# EasyEDA Pro project kuafu01_030内部老化方案.eprj, board PCB4 (continued)
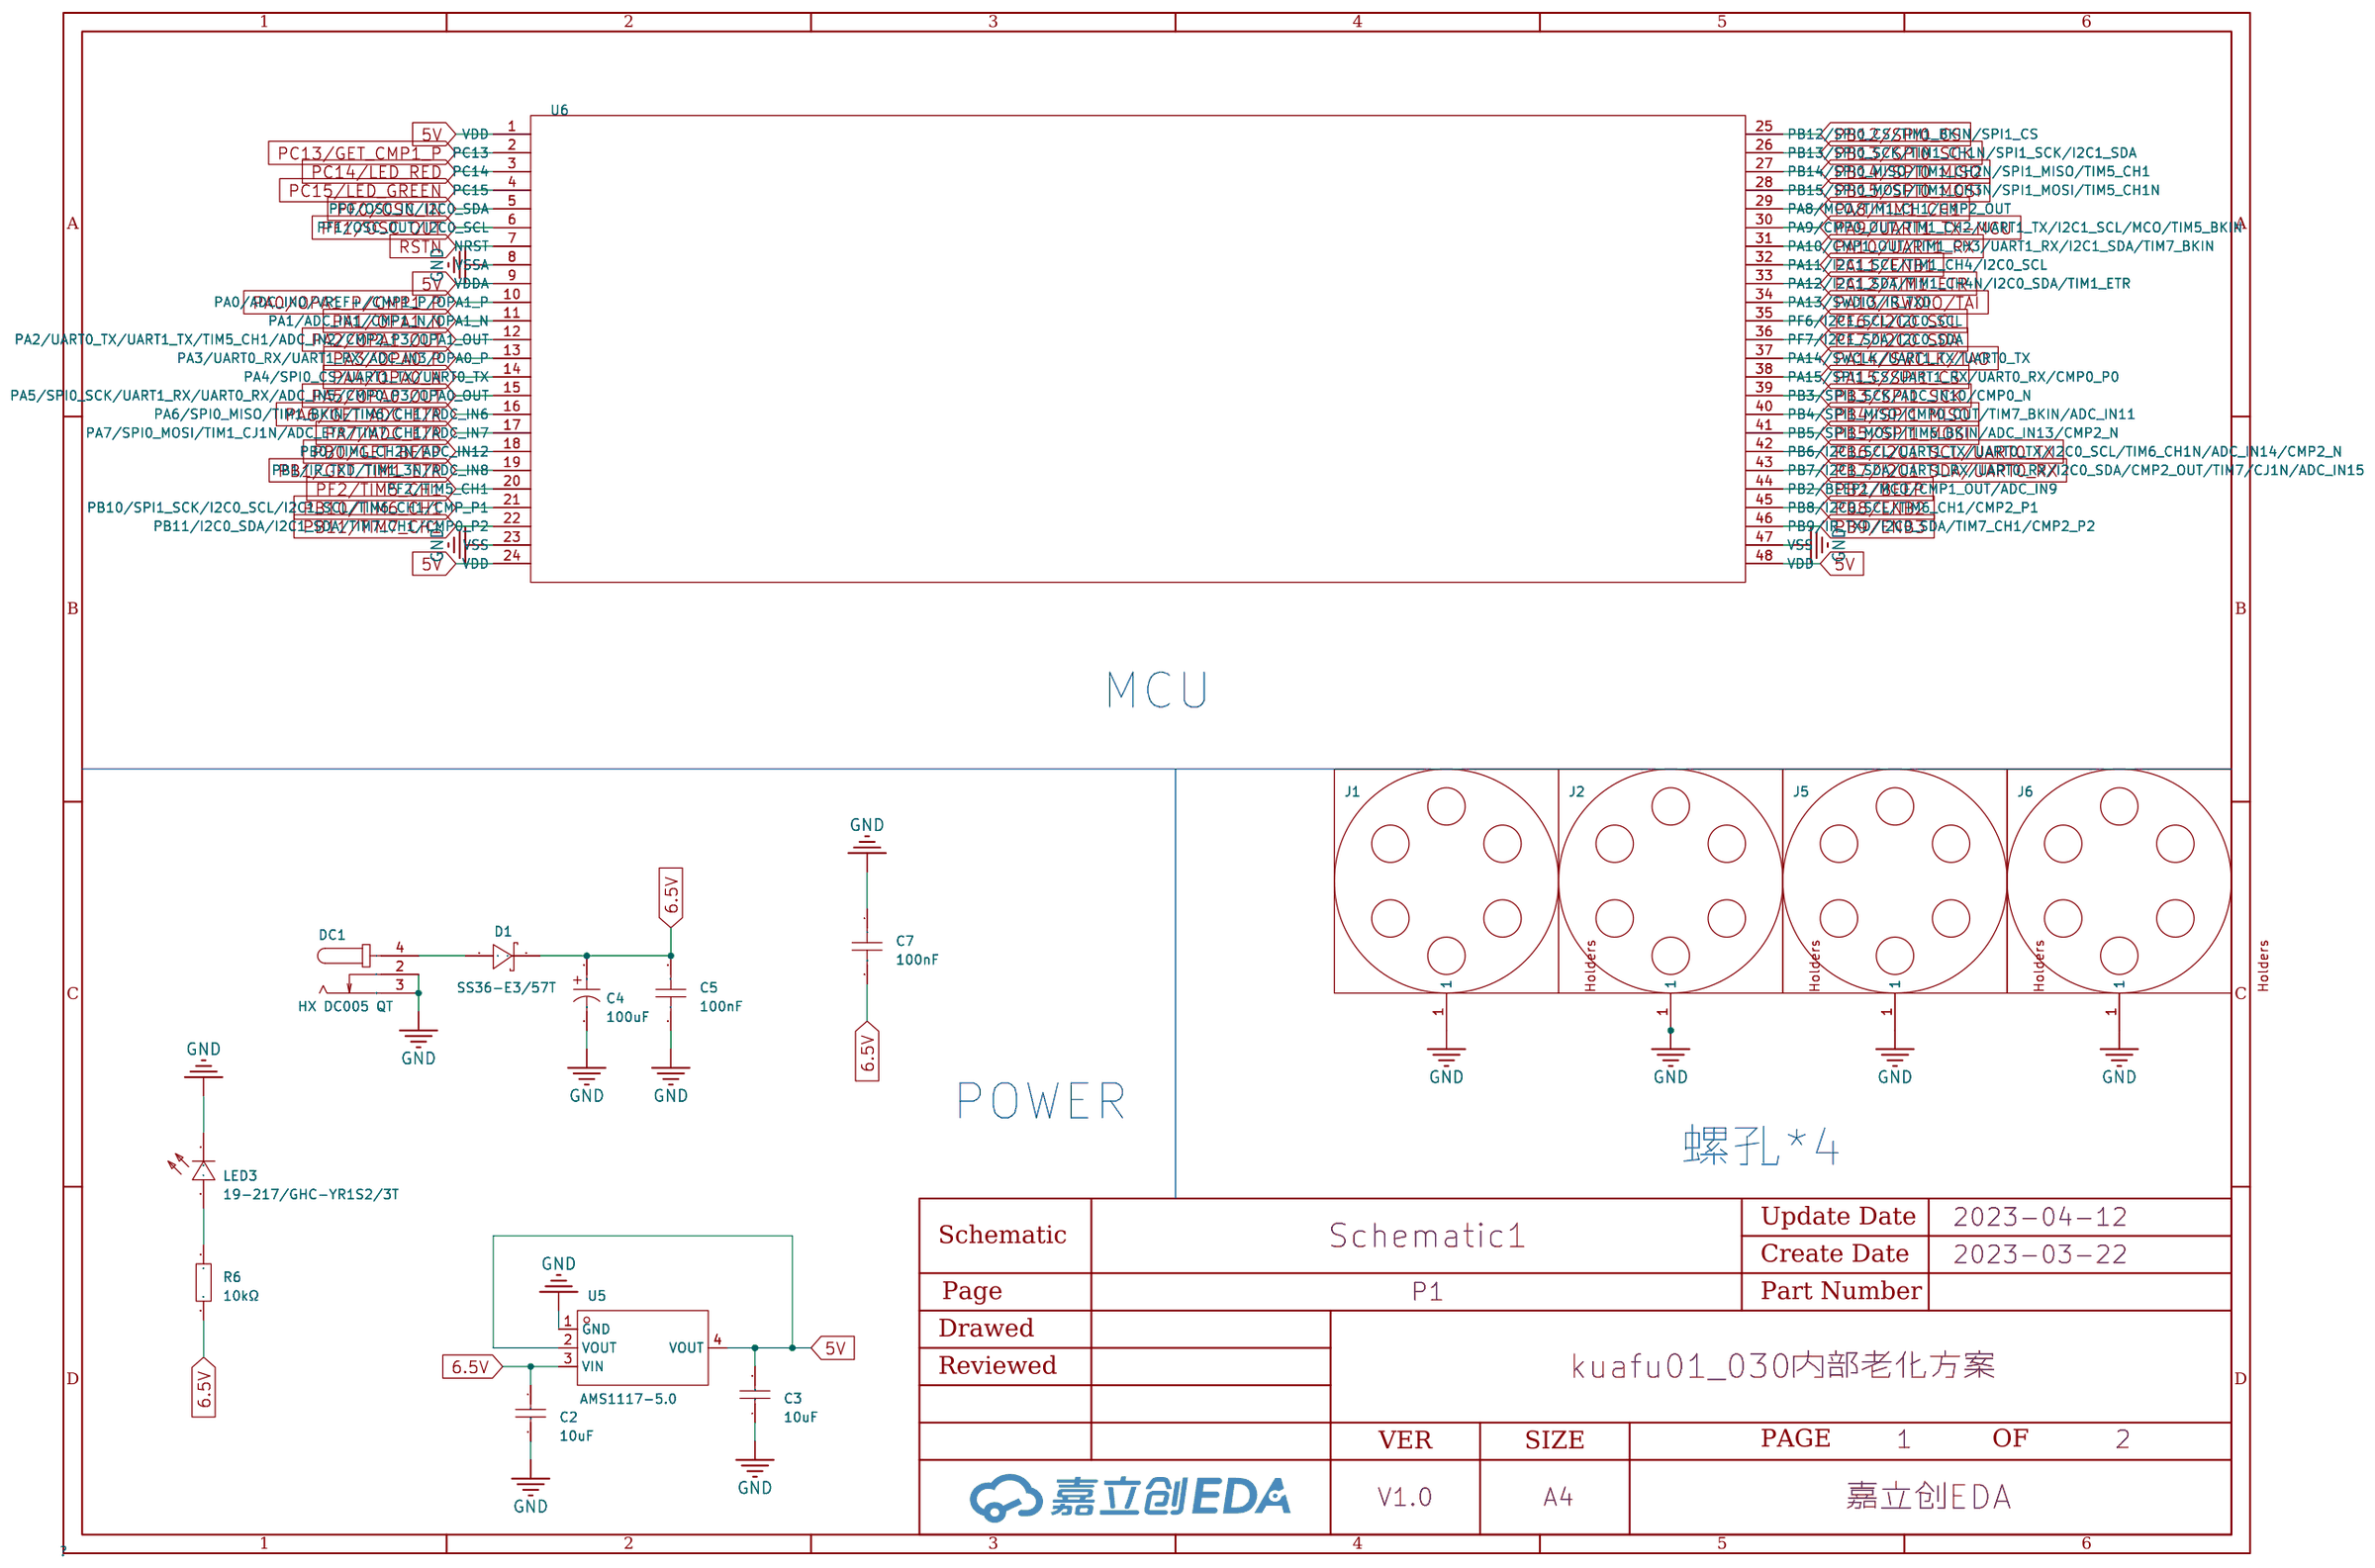
[diagram p0: P1]
## Routing (per net, layer and track width the routed paths; a pad name or vN(x,y) marks a point on that pad's centre or on a via; arc(x,y) is an arc through that point) (continued)
  Bottom Layer w0.381: v1(111.26,23.36) 111.16,23.47 111.16,31.54 110.28,32.42 109.28,32.42 v1(108.42,31.56) ; v1(260.82,133.16) 261.68,134.02 262.68,134.02 263.56,133.14 263.56,125.07 v1(263.66,124.96) ; v1(57.62,82.36) 58.48,83.22 59.48,83.22 60.36,82.34 60.36,74.27 v1(60.46,74.16) ; v1(240.62,22.94) 240.62,20.89 v1(240.61,20.88) ; v1(98.77,52.12) 99.2,52.55 107.4,52.55 109.12,50.84 109.12,47.96 106.27,45.11 106.27,41.39 106.22,41.33 106.22,40.16 106.16,40.1 v1(106.12,40.1) ; v1(189.82,124.54) 189.82,122.49 v1(189.81,122.48) ; v1(189.82,175.34) 189.82,173.29 v1(189.81,173.28) ; v1(210.02,31.56) 210.88,32.42 211.88,32.42 212.76,31.54 212.76,23.47 v1(212.86,23.36) ; v1(57.62,285.56) 58.48,286.42 59.48,286.42 60.36,285.54 60.36,277.47 v1(60.46,277.36) ; v1(189.82,276.94) 189.82,274.89 v1(189.81,274.88) ; v1(291.42,327.74) 291.42,325.69 v1(291.41,325.68) ; v1(37.41,173.28) 37.42,173.29 v1(37.42,175.34) ; v1(309.32,141.7) 309.36,141.7 309.42,141.76 309.42,142.93 309.47,142.99 309.47,146.71 312.32,149.56 312.32,152.44 310.6,154.15 302.4,154.15 v1(301.97,153.72) ; v1(260.82,31.56) 261.68,32.42 262.68,32.42 263.56,31.54 263.56,23.47 v1(263.66,23.36) ; v1(159.22,234.76) 160.08,235.62 161.08,235.62 161.96,234.74 161.96,226.67 v1(162.06,226.56) ; v1(159.22,336.36) 160.08,337.22 161.08,337.22 161.96,336.34 161.96,328.27 v1(162.06,328.16) ; v1(55.32,192.5) 55.36,192.5 55.42,192.56 55.42,193.73 55.47,193.79 55.47,197.51 58.32,200.36 58.32,203.24 56.6,204.95 48.4,204.95 v1(47.97,204.52) ; v1(111.26,277.36) 111.16,277.47 111.16,285.54 110.28,286.42 109.28,286.42 v1(108.42,285.56) ; v1(260.82,336.36) 261.68,337.22 262.68,337.22 263.56,336.34 263.56,328.27 v1(263.66,328.16) ; v1(200.37,52.12) 200.8,52.55 209,52.55 210.72,50.84 210.72,47.96 207.87,45.11 207.87,41.39 207.82,41.33 207.82,40.16 207.76,40.1 v1(207.72,40.1) ; v1(88.21,20.88) 88.22,20.89 v1(88.22,22.94) ; v1(309.32,344.9) 309.36,344.9 309.42,344.96 309.42,346.13 309.47,346.19 309.47,349.91 312.32,352.76 312.32,355.64 310.6,357.35 302.4,357.35 v1(301.97,356.92) ; v1(311.62,285.56) 312.48,286.42 313.48,286.42 314.36,285.54 314.36,277.47 v1(314.46,277.36) ; v1(240.61,122.48) 240.62,122.49 v1(240.62,124.54) ; v1(240.62,276.94) 240.62,274.89 v1(240.61,274.88) ; v1(139.01,274.88) 139.02,274.89 v1(139.02,276.94) ; v1(47.97,153.72) 48.4,154.15 56.6,154.15 58.32,152.44 58.32,149.56 55.47,146.71 55.47,142.99 55.42,142.93 55.42,141.76 55.36,141.7 v1(55.32,141.7) ; v1(108.42,183.96) 109.28,184.82 110.28,184.82 111.16,183.94 111.16,175.87 v1(111.26,175.76) ; v1(200.37,306.12) 200.8,306.55 209,306.55 210.72,304.84 210.72,301.96 207.87,299.11 207.87,295.39 207.82,295.33 207.82,294.16 207.76,294.1 v1(207.72,294.1) ; v1(189.82,226.14) 189.82,224.09 v1(189.81,224.08) ; v1(149.57,102.92) 150,103.35 158.2,103.35 159.92,101.64 159.92,98.76 157.07,95.91 157.07,92.19 157.02,92.13 157.02,90.96 156.96,90.9 v1(156.92,90.9) ; v1(200.37,204.52) 200.8,204.95 209,204.95 210.72,203.24 210.72,200.36 207.87,197.51 207.87,193.79 207.82,193.73 207.82,192.56 207.76,192.5 v1(207.72,192.5) ; v1(156.92,344.9) 156.96,344.9 157.02,344.96 157.02,346.13 157.07,346.19 157.07,349.91 159.92,352.76 159.92,355.64 158.2,357.35 150,357.35 v1(149.57,356.92) ; v1(311.62,82.36) 312.48,83.22 313.48,83.22 314.36,82.34 314.36,74.27 v1(314.46,74.16) ; v1(139.01,20.88) 139.02,20.89 v1(139.02,22.94) ; v1(311.62,183.96) 312.48,184.82 313.48,184.82 314.36,183.94 314.36,175.87 v1(314.46,175.76) ; v1(189.82,327.74) 189.82,325.69 v1(189.81,325.68) ; v1(98.77,255.32) 99.2,255.75 107.4,255.75 109.12,254.04 109.12,251.16 106.27,248.31 106.27,244.59 106.22,244.53 106.22,243.36 106.16,243.3 v1(106.12,243.3) ; v1(240.62,226.14) 240.62,224.09 v1(240.61,224.08) ; v1(106.12,141.7) 106.16,141.7 106.22,141.76 106.22,142.93 106.27,142.99 106.27,146.71 109.12,149.56 109.12,152.44 107.4,154.15 99.2,154.15 v1(98.77,153.72) ; v1(57.62,133.16) 58.48,134.02 59.48,134.02 60.36,133.14 60.36,125.07 v1(60.46,124.96) ; v1(139.02,175.34) 139.02,173.29 v1(139.01,173.28) ; v1(301.97,255.32) 302.4,255.75 310.6,255.75 312.32,254.04 312.32,251.16 309.47,248.31 309.47,244.59 309.42,244.53 309.42,243.36 309.36,243.3 v1(309.32,243.3) ; v1(88.22,226.14) 88.22,224.09 v1(88.21,224.08) ; v1(139.01,71.68) 139.02,71.69 v1(139.02,73.74) ; v1(162.06,74.16) 161.96,74.27 161.96,82.34 161.08,83.22 160.08,83.22 v1(159.22,82.36) ; v1(162.06,175.76) 161.96,175.87 161.96,183.94 161.08,184.82 160.08,184.82 v1(159.22,183.96) ; v1(156.92,294.1) 156.96,294.1 157.02,294.16 157.02,295.33 157.07,295.39 157.07,299.11 159.92,301.96 159.92,304.84 158.2,306.55 150,306.55 v1(149.57,306.12) ; v1(210.02,133.16) 210.88,134.02 211.88,134.02 212.76,133.14 212.76,125.07 v1(212.86,124.96) ; v1(251.17,356.92) 251.6,357.35 259.8,357.35 261.52,355.64 261.52,352.76 258.67,349.91 258.67,346.19 258.62,346.13 258.62,344.96 258.56,344.9 v1(258.52,344.9) ; v1(106.12,344.9) 106.16,344.9 106.22,344.96 106.22,346.13 106.27,346.19 106.27,349.91 109.12,352.76 109.12,355.64 107.4,357.35 99.2,357.35 v1(98.77,356.92) ; v1(240.62,73.74) 240.62,71.69 v1(240.61,71.68) ; v1(309.32,192.5) 309.36,192.5 309.42,192.56 309.42,193.73 309.47,193.79 309.47,197.51 312.32,200.36 312.32,203.24 310.6,204.95 302.4,204.95 v1(301.97,204.52) ; v1(258.52,90.9) 258.56,90.9 258.62,90.96 258.62,92.13 258.67,92.19 258.67,95.91 261.52,98.76 261.52,101.64 259.8,103.35 251.6,103.35 v1(251.17,102.92) ; v1(200.37,255.32) 200.8,255.75 209,255.75 210.72,254.04 210.72,251.16 207.87,248.31 207.87,244.59 207.82,244.53 207.82,243.36 207.76,243.3 v1(207.72,243.3) ; v1(251.17,204.52) 251.6,204.95 259.8,204.95 261.52,203.24 261.52,200.36 258.67,197.51 258.67,193.79 258.62,193.73 258.62,192.56 258.56,192.5 v1(258.52,192.5) ; v1(309.32,294.1) 309.36,294.1 309.42,294.16 309.42,295.33 309.47,295.39 309.47,299.11 312.32,301.96 312.32,304.84 310.6,306.55 302.4,306.55 v1(301.97,306.12) ; v1(260.82,285.56) 261.68,286.42 262.68,286.42 263.56,285.54 263.56,277.47 v1(263.66,277.36) ; v1(159.22,285.56) 160.08,286.42 161.08,286.42 161.96,285.54 161.96,277.47 v1(162.06,277.36) ; v1(189.82,73.74) 189.82,71.69 v1(189.81,71.68) ; v1(291.41,173.28) 291.42,173.29 v1(291.42,175.34) ; v1(212.86,74.16) 212.76,74.27 212.76,82.34 211.88,83.22 210.88,83.22 v1(210.02,82.36) ; v1(88.21,325.68) 88.22,325.69 v1(88.22,327.74) ; v1(55.32,40.1) 55.36,40.1 55.42,40.16 55.42,41.33 55.47,41.39 55.47,45.11 58.32,47.96 58.32,50.84 56.6,52.55 48.4,52.55 v1(47.97,52.12) ; v1(309.32,90.9) 309.36,90.9 309.42,90.96 309.42,92.13 309.47,92.19 309.47,95.91 312.32,98.76 312.32,101.64 310.6,103.35 302.4,103.35 v1(301.97,102.92) ; v1(60.46,175.76) 60.36,175.87 60.36,183.94 59.48,184.82 58.48,184.82 v1(57.62,183.96) ; v1(111.26,74.16) 111.16,74.27 111.16,82.34 110.28,83.22 109.28,83.22 v1(108.42,82.36) ; v1(210.02,183.96) 210.88,184.82 211.88,184.82 212.76,183.94 212.76,175.87 v1(212.86,175.76) ; v1(88.22,276.94) 88.22,274.89 v1(88.21,274.88) ; v1(210.02,285.56) 210.88,286.42 211.88,286.42 212.76,285.54 212.76,277.47 v1(212.86,277.36) ; v1(98.77,102.92) 99.2,103.35 107.4,103.35 109.12,101.64 109.12,98.76 106.27,95.91 106.27,92.19 106.22,92.13 106.22,90.96 106.16,90.9 v1(106.12,90.9) ; v1(258.52,40.1) 258.56,40.1 258.62,40.16 258.62,41.33 258.67,41.39 258.67,45.11 261.52,47.96 261.52,50.84 259.8,52.55 251.6,52.55 v1(251.17,52.12) ; v1(37.41,122.48) 37.42,122.49 v1(37.42,124.54) ; v1(106.12,192.5) 106.16,192.5 106.22,192.56 106.22,193.73 106.27,193.79 106.27,197.51 109.12,200.36 109.12,203.24 107.4,204.95 99.2,204.95 v1(98.77,204.52) ; v1(263.66,226.56) 263.56,226.67 263.56,234.74 262.68,235.62 261.68,235.62 v1(260.82,234.76) ; v1(291.42,73.74) 291.42,71.69 v1(291.41,71.68) ; v1(149.57,52.12) 150,52.55 158.2,52.55 159.92,50.84 159.92,47.96 157.07,45.11 157.07,41.39 157.02,41.33 157.02,40.16 156.96,40.1 v1(156.92,40.1) ; v1(251.17,306.12) 251.6,306.55 259.8,306.55 261.52,304.84 261.52,301.96 258.67,299.11 258.67,295.39 258.62,295.33 258.62,294.16 258.56,294.1 v1(258.52,294.1) ; v1(314.46,328.16) 314.36,328.27 314.36,336.34 313.48,337.22 312.48,337.22 v1(311.62,336.36) ; v1(260.82,82.36) 261.68,83.22 262.68,83.22 263.56,82.34 263.56,74.27 v1(263.66,74.16) ; v1(212.86,328.16) 212.76,328.27 212.76,336.34 211.88,337.22 210.88,337.22 v1(210.02,336.36) ; v1(139.02,124.54) 139.02,122.49 v1(139.01,122.48) ; v1(207.72,90.9) 207.76,90.9 207.82,90.96 207.82,92.13 207.87,92.19 207.87,95.91 210.72,98.76 210.72,101.64 209,103.35 200.8,103.35 v1(200.37,102.92) ; v1(88.21,122.48) 88.22,122.49 v1(88.22,124.54) ; v1(108.42,234.76) 109.28,235.62 110.28,235.62 111.16,234.74 111.16,226.67 v1(111.26,226.56) ; v1(139.02,327.74) 139.02,325.69 v1(139.01,325.68) ; v1(111.26,328.16) 111.16,328.27 111.16,336.34 110.28,337.22 109.28,337.22 v1(108.42,336.36) ; v1(98.77,306.12) 99.2,306.55 107.4,306.55 109.12,304.84 109.12,301.96 106.27,299.11 106.27,295.39 106.22,295.33 106.22,294.16 106.16,294.1 v1(106.12,294.1) ; v1(47.97,255.32) 48.4,255.75 56.6,255.75 58.32,254.04 58.32,251.16 55.47,248.31 55.47,244.59 55.42,244.53 55.42,243.36 55.36,243.3 v1(55.32,243.3) ; v1(207.72,141.7) 207.76,141.7 207.82,141.76 207.82,142.93 207.87,142.99 207.87,146.71 210.72,149.56 210.72,152.44 209,154.15 200.8,154.15 v1(200.37,153.72) ; v1(212.86,226.56) 212.76,226.67 212.76,234.74 211.88,235.62 210.88,235.62 v1(210.02,234.76) ; v1(149.57,153.72) 150,154.15 158.2,154.15 159.92,152.44 159.92,149.56 157.07,146.71 157.07,142.99 157.02,142.93 157.02,141.76 156.96,141.7 v1(156.92,141.7) ; v1(162.06,23.36) 161.96,23.47 161.96,31.54 161.08,32.42 160.08,32.42 v1(159.22,31.56) ; v1(156.92,192.5) 156.96,192.5 157.02,192.56 157.02,193.73 157.07,193.79 157.07,197.51 159.92,200.36 159.92,203.24 158.2,204.95 150,204.95 v1(149.57,204.52) ; v1(291.41,274.88) 291.42,274.89 v1(291.42,276.94) ; v1(291.41,122.48) 291.42,122.49 v1(291.42,124.54) ; v1(207.72,344.9) 207.76,344.9 207.82,344.96 207.82,346.13 207.87,346.19 207.87,349.91 210.72,352.76 210.72,355.64 209,357.35 200.8,357.35 v1(200.37,356.92) ; v1(139.01,224.08) 139.02,224.09 v1(139.02,226.14) ; v1(88.21,71.68) 88.22,71.69 v1(88.22,73.74) ; v1(251.17,153.72) 251.6,154.15 259.8,154.15 261.52,152.44 261.52,149.56 258.67,146.71 258.67,142.99 258.62,142.93 258.62,141.76 258.56,141.7 v1(258.52,141.7) ; v1(260.82,183.96) 261.68,184.82 262.68,184.82 263.56,183.94 263.56,175.87 v1(263.66,175.76) ; v1(311.62,234.76) 312.48,235.62 313.48,235.62 314.36,234.74 314.36,226.67 v1(314.46,226.56) ; v1(189.82,22.94) 189.82,20.89 v1(189.81,20.88) ; v1(37.41,224.08) 37.42,224.09 v1(37.42,226.14) ; v1(162.06,124.96) 161.96,125.07 161.96,133.14 161.08,134.02 160.08,134.02 v1(159.22,133.16) ; v1(60.46,226.56) 60.36,226.67 60.36,234.74 59.48,235.62 58.48,235.62 v1(57.62,234.76) ; v1(88.21,173.28) 88.22,173.29 v1(88.22,175.34) ; v1(311.62,133.16) 312.48,134.02 313.48,134.02 314.36,133.14 314.36,125.07 v1(314.46,124.96) ; v1(47.97,102.92) 48.4,103.35 56.6,103.35 58.32,101.64 58.32,98.76 55.47,95.91 55.47,92.19 55.42,92.13 55.42,90.96 55.36,90.9 v1(55.32,90.9) ; v1(258.52,243.3) 258.56,243.3 258.62,243.36 258.62,244.53 258.67,244.59 258.67,248.31 261.52,251.16 261.52,254.04 259.8,255.75 251.6,255.75 v1(251.17,255.32) ; v1(55.32,294.1) 55.36,294.1 55.42,294.16 55.42,295.33 55.47,295.39 55.47,299.11 58.32,301.96 58.32,304.84 56.6,306.55 48.4,306.55 v1(47.97,306.12) ; v1(57.62,31.56) 58.48,32.42 59.48,32.42 60.36,31.54 60.36,23.47 v1(60.46,23.36) ; v1(156.92,243.3) 156.96,243.3 157.02,243.36 157.02,244.53 157.07,244.59 157.07,248.31 159.92,251.16 159.92,254.04 158.2,255.75 150,255.75 v1(149.57,255.32) ; v1(291.42,226.14) 291.42,224.09 v1(291.41,224.08) ; v1(240.61,173.28) 240.62,173.29 v1(240.62,175.34) ; v1(111.26,124.96) 111.16,125.07 111.16,133.14 110.28,134.02 109.28,134.02 v1(108.42,133.16) ; v1(37.41,71.68) 37.42,71.69 v1(37.42,73.74) ; v1(240.61,325.68) 240.62,325.69 v1(240.62,327.74) ; v1(37.42,22.94) 37.42,20.89 v1(37.41,20.88) ; v1(37.41,274.88) 37.42,274.89 v1(37.42,276.94)
  Bottom Layer w0.508: v1(251.17,306.12) 251.17,309.92 v1(251.21,309.97) ; v1(240.62,73.74) 236.94,77.43 v1(236.94,80.16) ; 244.03,277.73 244.03,279.75 245.96,281.69 245.96,288.24 v1(245.97,288.25) 245.97,288.25 v1(245.97,290.12) ; v1(258.39,169.75) 258.39,170.46 258.4,170.47 v1(258.4,172.64) ; v1(250.78,164.02) 250.78,165.04 251.23,165.49 v1(254.67,165.49) ; v1(258.39,118.95) 258.39,119.66 258.4,119.67 v1(258.4,121.84) ; v1(195.17,36.12) 195.17,34.25 v1(195.17,34.25) 195.16,34.24 195.16,27.69 193.23,25.75 193.23,23.73 ; v1(207.6,121.84) 207.6,119.67 207.59,119.66 v1(207.59,118.95) ; v1(84.54,181.76) 84.54,179.03 v1(88.22,175.34) ; v1(291.42,327.74) 287.74,331.43 v1(287.74,334.16) ; 294.83,176.13 294.83,178.15 296.76,180.09 296.76,186.64 v1(296.77,186.65) 296.77,186.65 v1(296.77,188.52) ; v1(189.82,175.34) 186.14,179.03 v1(186.14,181.76) ; v1(47.97,306.12) 47.97,309.92 v1(48.01,309.97) ; v1(102.27,267.09) 98.83,267.09 98.38,266.64 v1(98.38,265.62) ; 244.03,328.53 244.03,330.55 245.96,332.49 245.96,339.04 v1(245.97,339.05) 245.97,339.05 v1(245.97,340.92) ; v1(149.57,356.92) 149.57,360.72 v1(149.61,360.77) ; v1(258.39,68.15) 258.39,68.86 258.4,68.87 v1(258.4,71.04) ; v1(48.01,55.97) 47.97,55.92 v1(47.97,52.12) ; v1(203.87,165.49) 200.43,165.49 199.98,165.04 v1(199.98,164.02) ; 244.03,125.33 244.03,127.35 245.96,129.29 245.96,135.84 v1(245.97,135.85) 245.97,135.85 v1(245.97,137.72) ; v1(240.62,276.94) 236.94,280.63 v1(236.94,283.36) ; v1(297.43,169.21) 294.23,166.01 v1(292.75,166.01) ; v1(98.81,259.17) 98.77,259.12 v1(98.77,255.32) ; 142.43,277.73 142.43,279.75 144.36,281.69 144.36,288.24 v1(144.37,288.25) 144.37,288.25 v1(144.37,290.12) ; 244.03,226.93 244.03,228.95 245.96,230.89 245.96,237.44 v1(245.97,237.45) 245.97,237.45 v1(245.97,239.32) ; v1(305.47,317.89) 302.03,317.89 301.58,317.44 v1(301.58,316.42) ; v1(200.41,259.17) 200.37,259.12 v1(200.37,255.32) ; v1(102.27,63.89) 98.83,63.89 98.38,63.44 v1(98.38,62.42) ; v1(240.62,124.54) 236.94,128.23 v1(236.94,130.96) ; v1(191.15,166.01) 192.63,166.01 v1(195.83,169.21) ; 193.23,125.33 193.23,127.35 195.16,129.29 195.16,135.84 v1(195.17,135.85) 195.17,135.85 v1(195.17,137.72) ; v1(186.14,29.36) 186.14,26.63 v1(189.82,22.94) ; v1(149.57,306.12) 149.57,309.92 v1(149.61,309.97) ; 294.83,125.33 294.83,127.35 296.76,129.29 296.76,135.84 v1(296.77,135.85) 296.77,135.85 v1(296.77,137.72) ; v1(189.82,226.14) 186.14,229.83 v1(186.14,232.56) ; v1(258.4,20.24) 258.4,18.07 258.39,18.06 v1(258.39,17.35) ; v1(89.55,216.81) 91.03,216.81 v1(94.23,220.01) ; v1(55.2,172.64) 55.2,170.47 55.19,170.46 v1(55.19,169.75) ; v1(55.2,121.84) 55.2,119.67 55.19,119.66 v1(55.19,118.95) ; v1(251.21,157.57) 251.17,157.52 v1(251.17,153.72) ; v1(149.61,55.97) 149.57,55.92 v1(149.57,52.12) ; v1(153.07,216.29) 149.63,216.29 149.18,215.84 v1(149.18,214.82) ; v1(292.75,115.21) 294.23,115.21 v1(297.43,118.41) ; v1(156.79,118.95) 156.79,119.66 156.8,119.67 v1(156.8,121.84) ; v1(140.35,64.41) 141.83,64.41 v1(145.03,67.61) ; v1(42.77,239.32) 42.77,237.45 v1(42.77,237.45) 42.76,237.44 42.76,230.89 40.83,228.95 40.83,226.93 ; v1(309.2,172.64) 309.2,170.47 309.19,170.46 v1(309.19,169.75) ; v1(93.57,137.72) 93.57,135.85 v1(93.57,135.85) 93.56,135.84 93.56,129.29 91.63,127.35 91.63,125.33 ; v1(240.62,175.34) 236.94,179.03 v1(236.94,181.76) ; v1(246.63,169.21) 243.43,166.01 v1(241.95,166.01) ; v1(43.43,67.61) 40.23,64.41 v1(38.75,64.41) ; v1(135.34,232.56) 135.34,229.83 v1(139.02,226.14) ; v1(251.17,204.52) 251.17,208.32 v1(251.21,208.37) ; v1(207.59,322.15) 207.59,322.86 207.6,322.87 v1(207.6,325.04) ; v1(102.27,216.29) 98.83,216.29 98.38,215.84 v1(98.38,214.82) ; v1(302.01,157.57) 301.97,157.52 v1(301.97,153.72) ; v1(199.98,62.42) 199.98,63.44 200.43,63.89 v1(203.87,63.89) ; v1(287.74,232.56) 287.74,229.83 v1(291.42,226.14) ; v1(291.42,175.34) 287.74,179.03 v1(287.74,181.76) ; v1(199.98,113.22) 199.98,114.24 200.43,114.69 v1(203.87,114.69) ; v1(250.78,214.82) 250.78,215.84 251.23,216.29 v1(254.67,216.29) ; v1(189.82,124.54) 186.14,128.23 v1(186.14,130.96) ; v1(38.75,115.21) 40.23,115.21 v1(43.43,118.41) ; v1(89.55,318.41) 91.03,318.41 v1(94.23,321.61) ; v1(105.99,169.75) 105.99,170.46 106,170.47 v1(106,172.64) ; v1(203.87,13.09) 200.43,13.09 199.98,12.64 v1(199.98,11.62) ; v1(302.01,208.37) 301.97,208.32 v1(301.97,204.52) ; v1(135.34,283.36) 135.34,280.63 v1(139.02,276.94) ; v1(250.78,113.22) 250.78,114.24 251.23,114.69 v1(254.67,114.69) ; v1(241.95,64.41) 243.43,64.41 v1(246.63,67.61) ; v1(309.2,325.04) 309.2,322.87 309.19,322.86 v1(309.19,322.15) ; v1(98.38,11.62) 98.38,12.64 98.83,13.09 v1(102.27,13.09) ; 294.83,328.53 294.83,330.55 296.76,332.49 296.76,339.04 v1(296.77,339.05) 296.77,339.05 v1(296.77,340.92) ; v1(140.35,216.81) 141.83,216.81 v1(145.03,220.01) ; v1(33.74,283.36) 33.74,280.63 v1(37.42,276.94) ; v1(55.2,20.24) 55.2,18.07 55.19,18.06 v1(55.19,17.35) ; v1(93.57,36.12) 93.57,34.25 v1(93.57,34.25) 93.56,34.24 93.56,27.69 91.63,25.75 91.63,23.73 ; v1(203.87,317.89) 200.43,317.89 199.98,317.44 v1(199.98,316.42) ; v1(98.77,204.52) 98.77,208.32 v1(98.81,208.37) ; v1(251.21,106.77) 251.17,106.72 v1(251.17,102.92) ; v1(195.17,290.12) 195.17,288.25 v1(195.17,288.25) 195.16,288.24 195.16,281.69 193.23,279.75 193.23,277.73 ; v1(139.02,175.34) 135.34,179.03 v1(135.34,181.76) ; 142.43,74.53 142.43,76.55 144.36,78.49 144.36,85.04 v1(144.37,85.05) 144.37,85.05 v1(144.37,86.92) ; v1(156.79,322.15) 156.79,322.86 156.8,322.87 v1(156.8,325.04) ; v1(156.79,169.75) 156.79,170.46 156.8,170.47 v1(156.8,172.64) ; v1(301.58,164.02) 301.58,165.04 302.03,165.49 v1(305.47,165.49) ; v1(291.42,73.74) 287.74,77.43 v1(287.74,80.16) ; v1(245.97,86.92) 245.97,85.05 v1(245.97,85.05) 245.96,85.04 245.96,78.49 244.03,76.55 244.03,74.53 ; v1(297.43,270.81) 294.23,267.61 v1(292.75,267.61) ; v1(144.37,239.32) 144.37,237.45 v1(144.37,237.45) 144.36,237.44 144.36,230.89 142.43,228.95 142.43,226.93 ; v1(258.39,322.15) 258.39,322.86 258.4,322.87 v1(258.4,325.04) ; v1(254.67,317.89) 251.23,317.89 250.78,317.44 v1(250.78,316.42) ; v1(88.22,124.54) 84.54,128.23 v1(84.54,130.96) ; v1(42.77,137.72) 42.77,135.85 v1(42.77,135.85) 42.76,135.84 42.76,129.29 40.83,127.35 40.83,125.33 ; v1(200.37,204.52) 200.37,208.32 v1(200.41,208.37) ; v1(88.22,73.74) 84.54,77.43 v1(84.54,80.16) ; v1(89.55,166.01) 91.03,166.01 v1(94.23,169.21) ; v1(156.8,71.04) 156.8,68.87 156.79,68.86 v1(156.79,68.15) ; v1(48.01,106.77) 47.97,106.72 v1(47.97,102.92) ; v1(200.37,356.92) 200.37,360.72 v1(200.41,360.77) ; v1(207.59,220.55) 207.59,221.26 207.6,221.27 v1(207.6,223.44) ; v1(297.43,321.61) 294.23,318.41 v1(292.75,318.41) ; 40.83,74.53 40.83,76.55 42.76,78.49 42.76,85.04 v1(42.77,85.05) 42.77,85.05 v1(42.77,86.92) ; v1(48.01,157.57) 47.97,157.52 v1(47.97,153.72) ; v1(105.99,118.95) 105.99,119.66 106,119.67 v1(106,121.84) ; 40.83,277.73 40.83,279.75 42.76,281.69 42.76,288.24 v1(42.77,288.25) 42.77,288.25 v1(42.77,290.12) ; v1(98.77,153.72) 98.77,157.52 v1(98.81,157.57) ; v1(47.58,113.22) 47.58,114.24 48.03,114.69 v1(51.47,114.69) ; v1(47.97,204.52) 47.97,208.32 v1(48.01,208.37) ; v1(37.42,22.94) 33.74,26.63 v1(33.74,29.36) ; v1(149.18,62.42) 149.18,63.44 149.63,63.89 v1(153.07,63.89) ; v1(135.34,80.16) 135.34,77.43 v1(139.02,73.74) ; v1(195.83,220.01) 192.63,216.81 v1(191.15,216.81) ; v1(98.77,356.92) 98.77,360.72 v1(98.81,360.77) ; 142.43,176.13 142.43,178.15 144.36,180.09 144.36,186.64 v1(144.37,186.65) 144.37,186.65 v1(144.37,188.52) ; v1(200.37,102.92) 200.37,106.72 v1(200.41,106.77) ; v1(207.6,172.64) 207.6,170.47 207.59,170.46 v1(207.59,169.75) ; v1(195.17,340.92) 195.17,339.05 v1(195.17,339.05) 195.16,339.04 195.16,332.49 193.23,330.55 193.23,328.53 ; v1(309.19,68.15) 309.19,68.86 309.2,68.87 v1(309.2,71.04) ; v1(287.74,130.96) 287.74,128.23 v1(291.42,124.54) ; v1(296.77,239.32) 296.77,237.45 v1(296.77,237.45) 296.76,237.44 296.76,230.89 294.83,228.95 294.83,226.93 ; v1(195.17,86.92) 195.17,85.05 v1(195.17,85.05) 195.16,85.04 195.16,78.49 193.23,76.55 193.23,74.53 ; v1(240.62,22.94) 236.94,26.63 v1(236.94,29.36) ; v1(149.61,259.17) 149.57,259.12 v1(149.57,255.32) ; v1(297.43,220.01) 294.23,216.81 v1(292.75,216.81) ; v1(145.03,118.41) 141.83,115.21 v1(140.35,115.21) ; v1(98.38,164.02) 98.38,165.04 98.83,165.49 v1(102.27,165.49) ; v1(145.03,16.81) 141.83,13.61 v1(140.35,13.61) ; v1(250.78,62.42) 250.78,63.44 251.23,63.89 v1(254.67,63.89) ; v1(98.38,316.42) 98.38,317.44 98.83,317.89 v1(102.27,317.89) ; v1(297.43,67.61) 294.23,64.41 v1(292.75,64.41) ; v1(105.99,68.15) 105.99,68.86 106,68.87 v1(106,71.04) ; v1(309.19,118.95) 309.19,119.66 309.2,119.67 v1(309.2,121.84) ; v1(89.55,115.21) 91.03,115.21 v1(94.23,118.41) ; v1(51.47,267.09) 48.03,267.09 47.58,266.64 v1(47.58,265.62) ; 193.23,226.93 193.23,228.95 195.16,230.89 195.16,237.44 v1(195.17,237.45) 195.17,237.45 v1(195.17,239.32) ; v1(200.37,52.12) 200.37,55.92 v1(200.41,55.97) ; v1(156.8,20.24) 156.8,18.07 156.79,18.06 v1(156.79,17.35) ; v1(258.4,223.44) 258.4,221.27 258.39,221.26 v1(258.39,220.55) ; v1(199.98,214.82) 199.98,215.84 200.43,216.29 v1(203.87,216.29) ; v1(189.82,73.74) 186.14,77.43 v1(186.14,80.16) ; v1(291.42,276.94) 287.74,280.63 v1(287.74,283.36) ; v1(37.42,124.54) 33.74,128.23 v1(33.74,130.96) ; v1(149.18,113.22) 149.18,114.24 149.63,114.69 v1(153.07,114.69) ; v1(200.41,309.97) 200.37,309.92 v1(200.37,306.12) ; v1(254.67,267.09) 251.23,267.09 250.78,266.64 v1(250.78,265.62) ; v1(149.57,102.92) 149.57,106.72 v1(149.61,106.77) ; 91.63,226.93 91.63,228.95 93.56,230.89 93.56,237.44 v1(93.57,237.45) 93.57,237.45 v1(93.57,239.32) ; v1(144.37,137.72) 144.37,135.85 v1(144.37,135.85) 144.36,135.84 144.36,129.29 142.43,127.35 142.43,125.33 ; v1(140.35,267.61) 141.83,267.61 v1(145.03,270.81) ; v1(51.47,216.29) 48.03,216.29 47.58,215.84 v1(47.58,214.82) ; v1(251.17,356.92) 251.17,360.72 v1(251.21,360.77) ; v1(98.81,106.77) 98.77,106.72 v1(98.77,102.92) ; v1(135.34,130.96) 135.34,128.23 v1(139.02,124.54) ; v1(84.54,232.56) 84.54,229.83 v1(88.22,226.14) ; v1(149.57,153.72) 149.57,157.52 v1(149.61,157.57) ; v1(84.54,283.36) 84.54,280.63 v1(88.22,276.94) ; v1(251.17,255.32) 251.17,259.12 v1(251.21,259.17) ; v1(47.97,255.32) 47.97,259.12 v1(48.01,259.17) ; v1(55.19,68.15) 55.19,68.86 55.2,68.87 v1(55.2,71.04) ; v1(33.74,181.76) 33.74,179.03 v1(37.42,175.34) ; v1(88.22,327.74) 84.54,331.43 v1(84.54,334.16) ; v1(149.18,164.02) 149.18,165.04 149.63,165.49 v1(153.07,165.49) ; v1(98.38,113.22) 98.38,114.24 98.83,114.69 v1(102.27,114.69) ; v1(195.17,188.52) 195.17,186.65 v1(195.17,186.65) 195.16,186.64 195.16,180.09 193.23,178.15 193.23,176.13 ; v1(98.77,306.12) 98.77,309.92 v1(98.81,309.97) ; v1(199.98,265.62) 199.98,266.64 200.43,267.09 v1(203.87,267.09) ; v1(191.15,115.21) 192.63,115.21 v1(195.83,118.41) ; v1(94.23,270.81) 91.03,267.61 v1(89.55,267.61) ; v1(245.97,188.52) 245.97,186.65 v1(245.97,186.65) 245.96,186.64 245.96,180.09 244.03,178.15 244.03,176.13 ; v1(37.42,73.74) 33.74,77.43 v1(33.74,80.16) ; v1(88.22,22.94) 84.54,26.63 v1(84.54,29.36) ; v1(47.58,62.42) 47.58,63.44 48.03,63.89 v1(51.47,63.89) ; 244.03,23.73 244.03,25.75 245.96,27.69 245.96,34.24 v1(245.97,34.25) 245.97,34.25 v1(245.97,36.12) ; v1(207.6,274.24) 207.6,272.07 207.59,272.06 v1(207.59,271.35) ; v1(149.18,265.62) 149.18,266.64 149.63,267.09 v1(153.07,267.09) ; v1(156.8,274.24) 156.8,272.07 156.79,272.06 v1(156.79,271.35) ; v1(33.74,232.56) 33.74,229.83 v1(37.42,226.14) ; v1(254.67,13.09) 251.23,13.09 250.78,12.64 v1(250.78,11.62) ; v1(105.99,220.55) 105.99,221.26 106,221.27 v1(106,223.44) ; v1(191.15,64.41) 192.63,64.41 v1(195.83,67.61) ; v1(207.6,20.24) 207.6,18.07 207.59,18.06 v1(207.59,17.35) ; v1(305.47,114.69) 302.03,114.69 301.58,114.24 v1(301.58,113.22) ; v1(296.77,86.92) 296.77,85.05 v1(296.77,85.05) 296.76,85.04 296.76,78.49 294.83,76.55 294.83,74.53 ; v1(145.03,169.21) 141.83,166.01 v1(140.35,166.01) ; v1(305.47,63.89) 302.03,63.89 301.58,63.44 v1(301.58,62.42) ; v1(309.19,220.55) 309.19,221.26 309.2,221.27 v1(309.2,223.44) ; v1(106,325.04) 106,322.87 105.99,322.86 v1(105.99,322.15) ; v1(42.77,36.12) 42.77,34.25 v1(42.77,34.25) 42.76,34.24 42.76,27.69 40.83,25.75 40.83,23.73 ; v1(309.2,274.24) 309.2,272.07 309.19,272.06 v1(309.19,271.35) ; 91.63,176.13 91.63,178.15 93.56,180.09 93.56,186.64 v1(93.57,186.65) 93.57,186.65 v1(93.57,188.52) ; v1(105.99,271.35) 105.99,272.06 106,272.07 v1(106,274.24) ; v1(191.15,267.61) 192.63,267.61 v1(195.83,270.81) ; v1(55.19,220.55) 55.19,221.26 55.2,221.27 v1(55.2,223.44) ; v1(139.02,22.94) 135.34,26.63 v1(135.34,29.36) ; v1(207.59,68.15) 207.59,68.86 207.6,68.87 v1(207.6,71.04) ; v1(301.58,265.62) 301.58,266.64 302.03,267.09 v1(305.47,267.09) ; v1(191.15,318.41) 192.63,318.41 v1(195.83,321.61) ; v1(149.18,11.62) 149.18,12.64 149.63,13.09 v1(153.07,13.09) ; v1(156.79,220.55) 156.79,221.26 156.8,221.27 v1(156.8,223.44) ; v1(189.82,327.74) 186.14,331.43 v1(186.14,334.16) ; v1(301.97,306.12) 301.97,309.92 v1(302.01,309.97) ; v1(236.94,232.56) 236.94,229.83 v1(240.62,226.14) ; v1(94.23,16.81) 91.03,13.61 v1(89.55,13.61) ; v1(246.63,16.81) 243.43,13.61 v1(241.95,13.61) ; v1(302.01,259.17) 301.97,259.12 v1(301.97,255.32) ; v1(43.43,220.01) 40.23,216.81 v1(38.75,216.81) ; v1(195.83,16.81) 192.63,13.61 v1(191.15,13.61) ; v1(149.18,316.42) 149.18,317.44 149.63,317.89 v1(153.07,317.89) ; v1(135.34,334.16) 135.34,331.43 v1(139.02,327.74) ; v1(200.37,153.72) 200.37,157.52 v1(200.41,157.57) ; v1(241.95,216.81) 243.43,216.81 v1(246.63,220.01) ; v1(94.23,67.61) 91.03,64.41 v1(89.55,64.41) ; v1(43.43,169.21) 40.23,166.01 v1(38.75,166.01) ; v1(236.94,334.16) 236.94,331.43 v1(240.62,327.74) ; v1(246.63,321.61) 243.43,318.41 v1(241.95,318.41) ; v1(145.03,321.61) 141.83,318.41 v1(140.35,318.41) ; v1(98.77,52.12) 98.77,55.92 v1(98.81,55.97) ; 142.43,23.73 142.43,25.75 144.36,27.69 144.36,34.24 v1(144.37,34.25) 144.37,34.25 v1(144.37,36.12) ; v1(55.19,271.35) 55.19,272.06 55.2,272.07 v1(55.2,274.24) ; v1(246.63,270.81) 243.43,267.61 v1(241.95,267.61) ; v1(301.97,102.92) 301.97,106.72 v1(302.01,106.77) ; v1(47.58,164.02) 47.58,165.04 48.03,165.49 v1(51.47,165.49) ; v1(258.39,271.35) 258.39,272.06 258.4,272.07 v1(258.4,274.24) ; v1(51.47,13.09) 48.03,13.09 47.58,12.64 v1(47.58,11.62) ; v1(186.14,283.36) 186.14,280.63 v1(189.82,276.94) ; v1(38.75,267.61) 40.23,267.61 v1(43.43,270.81) ; v1(251.17,52.12) 251.17,55.92 v1(251.21,55.97) ; 91.63,328.53 91.63,330.55 93.56,332.49 93.56,339.04 v1(93.57,339.05) 93.57,339.05 v1(93.57,340.92) ; v1(105.99,17.35) 105.99,18.06 106,18.07 v1(106,20.24) ; 142.43,328.53 142.43,330.55 144.36,332.49 144.36,339.04 v1(144.37,339.05) 144.37,339.05 v1(144.37,340.92) ; v1(149.57,204.52) 149.57,208.32 v1(149.61,208.37) ; v1(296.77,290.12) 296.77,288.25 v1(296.77,288.25) 296.76,288.24 296.76,281.69 294.83,279.75 294.83,277.73 ; v1(246.63,118.41) 243.43,115.21 v1(241.95,115.21) ; v1(38.75,13.61) 40.23,13.61 v1(43.43,16.81) ; v1(93.57,290.12) 93.57,288.25 v1(93.57,288.25) 93.56,288.24 93.56,281.69 91.63,279.75 91.63,277.73 ; 91.63,74.53 91.63,76.55 93.56,78.49 93.56,85.04 v1(93.57,85.05) 93.57,85.05 v1(93.57,86.92) ; v1(302.01,360.77) 301.97,360.72 v1(301.97,356.92) ; 40.83,176.13 40.83,178.15 42.76,180.09 42.76,186.64 v1(42.77,186.65) 42.77,186.65 v1(42.77,188.52) ; v1(305.47,216.29) 302.03,216.29 301.58,215.84 v1(301.58,214.82)
  vias: v1(40.86,277.59) v1(40.86,226.79) v1(40.86,175.99) v1(40.86,125.19) v1(40.86,74.39) v1(40.86,23.59) v1(91.66,328.39) v1(91.66,277.59) v1(91.66,226.79) v1(91.66,175.99) v1(91.66,125.19) v1(91.66,74.39) v1(91.66,23.59) v1(142.46,328.39) v1(142.46,277.59) v1(142.46,226.79) v1(142.46,175.99) v1(142.46,125.19) v1(142.46,74.39) v1(142.46,23.59) v1(193.26,328.39) v1(193.26,277.59) v1(193.26,226.79) v1(193.26,175.99) v1(193.26,125.19) v1(193.26,74.39) v1(193.26,23.59) v1(244.06,328.39) v1(244.06,277.59) v1(244.06,226.79) v1(244.06,175.99) v1(244.06,125.19) v1(244.06,74.39) v1(244.06,23.59) v1(294.86,328.39) v1(294.86,277.59) v1(294.86,226.79) v1(294.86,175.99) v1(294.86,125.19) v1(294.86,74.39)
